# EasyEDA Pro project kuafu01_030内部老化方案.eprj, board PCB4 (continued)
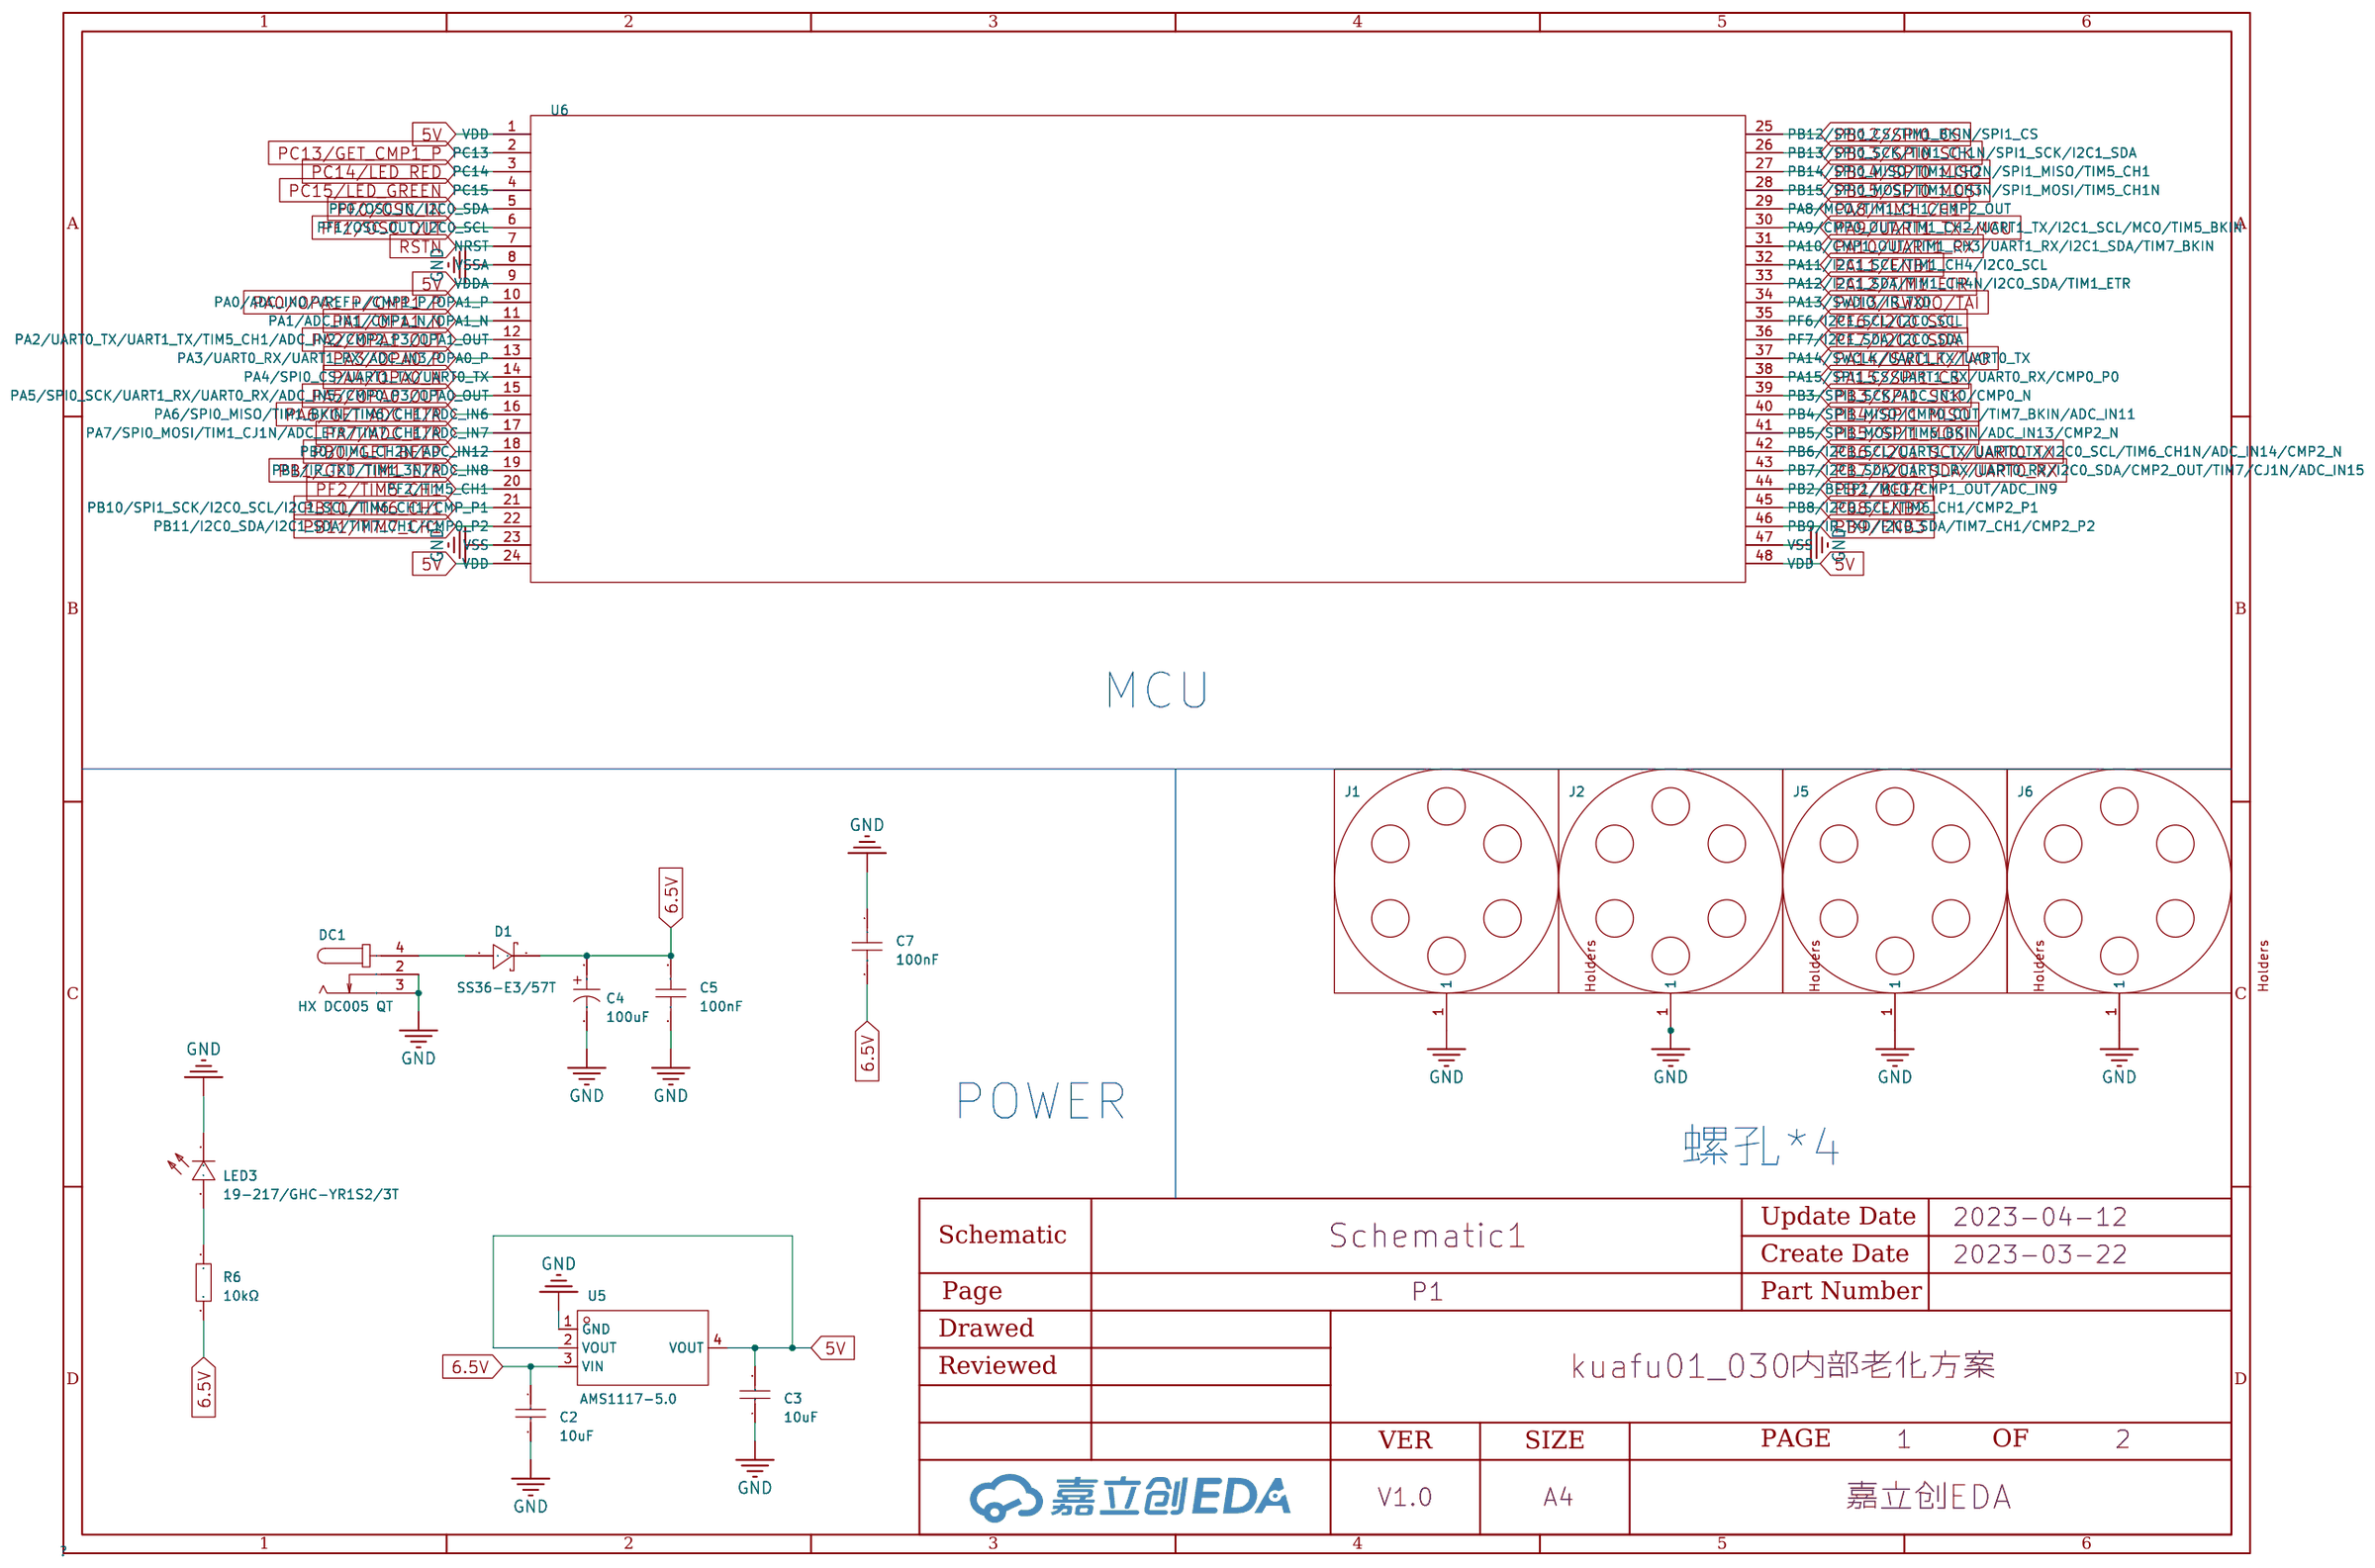
[diagram p0: P1]
## Routing (per net, layer and track width the routed paths; a pad name or vN(x,y) marks a point on that pad's centre or on a via; arc(x,y) is an arc through that point) (continued)
  Bottom Layer w0.254: v1(256.12,86.45) 256.06,86.39 253.49,86.39 v1(253.48,86.4) ; v1(205.32,35.65) 205.26,35.59 202.69,35.59 v1(202.68,35.6) ; v1(306.92,340.45) 306.86,340.39 304.29,340.39 v1(304.28,340.4) ; v1(101.08,137.2) 101.09,137.19 103.66,137.19 v1(103.72,137.25) ; v1(154.52,35.65) 154.46,35.59 151.89,35.59 v1(151.88,35.6) ; v1(103.72,238.85) 103.66,238.79 101.09,238.79 v1(101.08,238.8) ; v1(52.92,238.85) 52.86,238.79 50.29,238.79 v1(50.28,238.8) ; v1(306.92,137.25) 306.86,137.19 304.29,137.19 v1(304.28,137.2) ; v1(154.52,340.45) 154.46,340.39 151.89,340.39 v1(151.88,340.4) ; v1(256.12,289.65) 256.06,289.59 253.49,289.59 v1(253.48,289.6) ; v1(202.68,238.8) 202.69,238.79 205.26,238.79 v1(205.32,238.85) ; v1(154.52,86.45) 154.46,86.39 151.89,86.39 v1(151.88,86.4) ; v1(151.88,238.8) 151.89,238.79 154.46,238.79 v1(154.52,238.85) ; v1(50.28,137.2) 50.29,137.19 52.86,137.19 v1(52.92,137.25) ; v1(256.12,35.65) 256.06,35.59 253.49,35.59 v1(253.48,35.6) ; v1(253.48,137.2) 253.49,137.19 256.06,137.19 v1(256.12,137.25) ; v1(304.28,289.6) 304.29,289.59 306.86,289.59 v1(306.92,289.65) ; v1(306.92,86.45) 306.86,86.39 304.29,86.39 v1(304.28,86.4) ; v1(306.92,188.05) 306.86,187.99 304.29,187.99 v1(304.28,188) ; v1(151.88,137.2) 151.89,137.19 154.46,137.19 v1(154.52,137.25) ; v1(202.68,188) 202.69,187.99 205.26,187.99 v1(205.32,188.05) ; v1(205.32,86.45) 205.26,86.39 202.69,86.39 v1(202.68,86.4) ; v1(256.12,188.05) 256.06,187.99 253.49,187.99 v1(253.48,188) ; v1(256.12,238.85) 256.06,238.79 253.49,238.79 v1(253.48,238.8) ; v1(101.08,188) 101.09,187.99 103.66,187.99 v1(103.72,188.05) ; v1(101.08,289.6) 101.09,289.59 103.66,289.59 v1(103.72,289.65) ; v1(50.28,188) 50.29,187.99 52.86,187.99 v1(52.92,188.05) ; v1(103.72,35.65) 103.66,35.59 101.09,35.59 v1(101.08,35.6) ; v1(103.72,340.45) 103.66,340.39 101.09,340.39 v1(101.08,340.4) ; v1(202.68,340.4) 202.69,340.39 205.26,340.39 v1(205.32,340.45) ; v1(306.92,238.85) 306.86,238.79 304.29,238.79 v1(304.28,238.8) ; v1(52.92,289.65) 52.86,289.59 50.29,289.59 v1(50.28,289.6) ; v1(52.92,35.65) 52.86,35.59 50.29,35.59 v1(50.28,35.6) ; v1(151.88,188) 151.89,187.99 154.46,187.99 v1(154.52,188.05) ; v1(202.68,137.2) 202.69,137.19 205.26,137.19 v1(205.32,137.25) ; v1(103.72,86.45) 103.66,86.39 101.09,86.39 v1(101.08,86.4) ; v1(205.32,289.65) 205.26,289.59 202.69,289.59 v1(202.68,289.6) ; v1(52.92,86.45) 52.86,86.39 50.29,86.39 v1(50.28,86.4) ; v1(151.88,289.6) 151.89,289.59 154.46,289.59 v1(154.52,289.65) ; v1(256.12,340.45) 256.06,340.39 253.49,340.39 v1(253.48,340.4)
PB8/ENB2: length 540.1
  Top Layer w0.254: 304.39,133.1 304.39,134.36 304.06,134.69 304.06,135.22 v1(304.19,135.35) ; 253.59,336.3 253.59,337.56 253.26,337.89 253.26,338.42 v1(253.39,338.55) ; v1(157.11,81.58) 157.59,82.06 158.67,82.06 159.73,81.01 160.67,81.01 ; v1(50.19,135.35) 50.06,135.22 50.06,134.69 50.39,134.36 50.39,133.1 ; v1(253.39,135.35) 253.26,135.22 253.26,134.69 253.59,134.36 253.59,133.1 ; 313.07,335.01 312.13,335.01 311.07,336.06 309.99,336.06 v1(309.51,335.58) ; v1(309.51,233.98) 309.99,234.46 311.07,234.46 312.13,233.41 313.07,233.41 ; v1(258.71,132.38) 259.19,132.86 260.27,132.86 261.33,131.81 262.27,131.81 ; 202.79,285.5 202.79,286.76 202.46,287.09 202.46,287.62 v1(202.59,287.75) ; v1(309.51,284.78) 309.99,285.26 311.07,285.26 312.13,284.21 313.07,284.21 ; v1(50.19,236.95) 50.06,236.82 50.06,236.29 50.39,235.96 50.39,234.7 ; v1(157.11,284.78) 157.59,285.26 158.67,285.26 159.73,284.21 160.67,284.21 ; 59.07,284.21 58.13,284.21 57.07,285.26 55.99,285.26 v1(55.51,284.78) ; v1(202.59,33.75) 202.46,33.62 202.46,33.09 202.79,32.76 202.79,31.5 ; 151.99,183.9 151.99,185.16 151.66,185.49 151.66,186.02 v1(151.79,186.15) ; v1(202.59,338.55) 202.46,338.42 202.46,337.89 202.79,337.56 202.79,336.3 ; 211.47,335.01 210.53,335.01 209.47,336.06 208.39,336.06 v1(207.91,335.58) ; v1(207.91,183.18) 208.39,183.66 209.47,183.66 210.53,182.61 211.47,182.61 ; 101.19,82.3 101.19,83.56 100.86,83.89 100.86,84.42 v1(100.99,84.55) ; v1(106.31,81.58) 106.79,82.06 107.87,82.06 108.93,81.01 109.87,81.01 ; v1(258.71,335.58) 259.19,336.06 260.27,336.06 261.33,335.01 262.27,335.01 ; v1(100.99,33.75) 100.86,33.62 100.86,33.09 101.19,32.76 101.19,31.5 ; 151.99,336.3 151.99,337.56 151.66,337.89 151.66,338.42 v1(151.79,338.55) ; v1(106.31,284.78) 106.79,285.26 107.87,285.26 108.93,284.21 109.87,284.21 ; v1(157.11,233.98) 157.59,234.46 158.67,234.46 159.73,233.41 160.67,233.41 ; 304.39,183.9 304.39,185.16 304.06,185.49 304.06,186.02 v1(304.19,186.15) ; v1(151.79,84.55) 151.66,84.42 151.66,83.89 151.99,83.56 151.99,82.3 ; 59.07,81.01 58.13,81.01 57.07,82.06 55.99,82.06 v1(55.51,81.58) ; 109.87,30.21 108.93,30.21 107.87,31.26 106.79,31.26 v1(106.31,30.78) ; v1(207.91,233.98) 208.39,234.46 209.47,234.46 210.53,233.41 211.47,233.41 ; 262.27,81.01 261.33,81.01 260.27,82.06 259.19,82.06 v1(258.71,81.58) ; v1(106.31,233.98) 106.79,234.46 107.87,234.46 108.93,233.41 109.87,233.41 ; v1(258.71,183.18) 259.19,183.66 260.27,183.66 261.33,182.61 262.27,182.61 ; 202.79,82.3 202.79,83.56 202.46,83.89 202.46,84.42 v1(202.59,84.55) ; 160.67,30.21 159.73,30.21 158.67,31.26 157.59,31.26 v1(157.11,30.78) ; v1(202.59,135.35) 202.46,135.22 202.46,134.69 202.79,134.36 202.79,133.1 ; v1(151.79,33.75) 151.66,33.62 151.66,33.09 151.99,32.76 151.99,31.5 ; v1(253.39,287.75) 253.26,287.62 253.26,287.09 253.59,286.76 253.59,285.5 ; v1(309.51,81.58) 309.99,82.06 311.07,82.06 312.13,81.01 313.07,81.01 ; 304.39,285.5 304.39,286.76 304.06,287.09 304.06,287.62 v1(304.19,287.75) ; v1(100.99,236.95) 100.86,236.82 100.86,236.29 101.19,235.96 101.19,234.7 ; 59.07,182.61 58.13,182.61 57.07,183.66 55.99,183.66 v1(55.51,183.18) ; 50.39,183.9 50.39,185.16 50.06,185.49 50.06,186.02 v1(50.19,186.15) ; v1(151.79,236.95) 151.66,236.82 151.66,236.29 151.99,235.96 151.99,234.7 ; v1(100.99,287.75) 100.86,287.62 100.86,287.09 101.19,286.76 101.19,285.5 ; v1(106.31,132.38) 106.79,132.86 107.87,132.86 108.93,131.81 109.87,131.81 ; v1(258.71,284.78) 259.19,285.26 260.27,285.26 261.33,284.21 262.27,284.21 ; v1(309.51,132.38) 309.99,132.86 311.07,132.86 312.13,131.81 313.07,131.81 ; v1(157.11,183.18) 157.59,183.66 158.67,183.66 159.73,182.61 160.67,182.61 ; v1(100.99,186.15) 100.86,186.02 100.86,185.49 101.19,185.16 101.19,183.9 ; 202.79,183.9 202.79,185.16 202.46,185.49 202.46,186.02 v1(202.59,186.15) ; 50.39,31.5 50.39,32.76 50.06,33.09 50.06,33.62 v1(50.19,33.75) ; 253.59,31.5 253.59,32.76 253.26,33.09 253.26,33.62 v1(253.39,33.75) ; 151.99,133.1 151.99,134.36 151.66,134.69 151.66,135.22 v1(151.79,135.35) ; v1(50.19,287.75) 50.06,287.62 50.06,287.09 50.39,286.76 50.39,285.5 ; 211.47,30.21 210.53,30.21 209.47,31.26 208.39,31.26 v1(207.91,30.78) ; v1(304.19,236.95) 304.06,236.82 304.06,236.29 304.39,235.96 304.39,234.7 ; v1(207.91,132.38) 208.39,132.86 209.47,132.86 210.53,131.81 211.47,131.81 ; 160.67,335.01 159.73,335.01 158.67,336.06 157.59,336.06 v1(157.11,335.58) ; 262.27,233.41 261.33,233.41 260.27,234.46 259.19,234.46 v1(258.71,233.98) ; v1(55.51,132.38) 55.99,132.86 57.07,132.86 58.13,131.81 59.07,131.81 ; v1(304.19,84.55) 304.06,84.42 304.06,83.89 304.39,83.56 304.39,82.3 ; 101.19,133.1 101.19,134.36 100.86,134.69 100.86,135.22 v1(100.99,135.35) ; 313.07,182.61 312.13,182.61 311.07,183.66 309.99,183.66 v1(309.51,183.18) ; v1(50.19,84.55) 50.06,84.42 50.06,83.89 50.39,83.56 50.39,82.3 ; v1(55.51,233.98) 55.99,234.46 57.07,234.46 58.13,233.41 59.07,233.41 ; v1(304.19,338.55) 304.06,338.42 304.06,337.89 304.39,337.56 304.39,336.3 ; 262.27,30.21 261.33,30.21 260.27,31.26 259.19,31.26 v1(258.71,30.78) ; v1(55.51,30.78) 55.99,31.26 57.07,31.26 58.13,30.21 59.07,30.21 ; v1(253.39,84.55) 253.26,84.42 253.26,83.89 253.59,83.56 253.59,82.3 ; 211.47,81.01 210.53,81.01 209.47,82.06 208.39,82.06 v1(207.91,81.58) ; 101.19,336.3 101.19,337.56 100.86,337.89 100.86,338.42 v1(100.99,338.55) ; v1(106.31,183.18) 106.79,183.66 107.87,183.66 108.93,182.61 109.87,182.61 ; v1(151.79,287.75) 151.66,287.62 151.66,287.09 151.99,286.76 151.99,285.5 ; v1(253.39,236.95) 253.26,236.82 253.26,236.29 253.59,235.96 253.59,234.7 ; 211.47,284.21 210.53,284.21 209.47,285.26 208.39,285.26 v1(207.91,284.78) ; 253.59,183.9 253.59,185.16 253.26,185.49 253.26,186.02 v1(253.39,186.15) ; v1(157.11,132.38) 157.59,132.86 158.67,132.86 159.73,131.81 160.67,131.81 ; v1(202.59,236.95) 202.46,236.82 202.46,236.29 202.79,235.96 202.79,234.7 ; 109.87,335.01 108.93,335.01 107.87,336.06 106.79,336.06 v1(106.31,335.58)
  Bottom Layer w0.254: v1(157.11,233.98) 156.73,233.98 153.39,237.32 152.16,237.32 v1(151.79,236.95) ; v1(151.79,135.35) 152.16,135.72 153.39,135.72 156.73,132.38 v1(157.11,132.38) ; v1(202.59,287.75) 202.96,288.12 204.19,288.12 207.53,284.78 v1(207.91,284.78) ; v1(207.91,30.78) 207.53,30.78 204.19,34.12 202.96,34.12 v1(202.59,33.75) ; v1(309.51,284.78) 309.13,284.78 305.79,288.12 304.56,288.12 v1(304.19,287.75) ; v1(304.19,135.35) 304.56,135.72 305.79,135.72 309.13,132.38 v1(309.51,132.38) ; v1(100.99,287.75) 101.36,288.12 102.59,288.12 105.93,284.78 v1(106.31,284.78) ; v1(258.71,183.18) 258.33,183.18 254.99,186.52 253.76,186.52 v1(253.39,186.15) ; v1(50.19,186.15) 50.56,186.52 51.79,186.52 55.13,183.18 v1(55.51,183.18) ; v1(309.51,183.18) 309.13,183.18 305.79,186.52 304.56,186.52 v1(304.19,186.15) ; v1(202.59,338.55) 202.96,338.92 204.19,338.92 207.53,335.58 v1(207.91,335.58) ; v1(100.99,135.35) 101.36,135.72 102.59,135.72 105.93,132.38 v1(106.31,132.38) ; v1(207.91,81.58) 207.53,81.58 204.19,84.92 202.96,84.92 v1(202.59,84.55) ; v1(207.91,132.38) 207.53,132.38 204.19,135.72 202.96,135.72 v1(202.59,135.35) ; v1(55.51,132.38) 55.13,132.38 51.79,135.72 50.56,135.72 v1(50.19,135.35) ; v1(304.19,338.55) 304.56,338.92 305.79,338.92 309.13,335.58 v1(309.51,335.58) ; v1(258.71,132.38) 258.33,132.38 254.99,135.72 253.76,135.72 v1(253.39,135.35) ; v1(253.39,338.55) 253.76,338.92 254.99,338.92 258.33,335.58 v1(258.71,335.58) ; v1(106.31,233.98) 105.93,233.98 102.59,237.32 101.36,237.32 v1(100.99,236.95) ; v1(106.31,81.58) 105.93,81.58 102.59,84.92 101.36,84.92 v1(100.99,84.55) ; v1(157.11,284.78) 156.73,284.78 153.39,288.12 152.16,288.12 v1(151.79,287.75) ; v1(151.79,84.55) 152.16,84.92 153.39,84.92 156.73,81.58 v1(157.11,81.58) ; v1(50.19,84.55) 50.56,84.92 51.79,84.92 55.13,81.58 v1(55.51,81.58) ; v1(157.11,335.58) 156.73,335.58 153.39,338.92 152.16,338.92 v1(151.79,338.55) ; v1(151.79,33.75) 152.16,34.12 153.39,34.12 156.73,30.78 v1(157.11,30.78) ; v1(253.39,236.95) 253.76,237.32 254.99,237.32 258.33,233.98 v1(258.71,233.98) ; v1(151.79,186.15) 152.16,186.52 153.39,186.52 156.73,183.18 v1(157.11,183.18) ; v1(253.39,287.75) 253.76,288.12 254.99,288.12 258.33,284.78 v1(258.71,284.78) ; v1(55.51,284.78) 55.13,284.78 51.79,288.12 50.56,288.12 v1(50.19,287.75) ; v1(258.71,81.58) 258.33,81.58 254.99,84.92 253.76,84.92 v1(253.39,84.55) ; v1(100.99,338.55) 101.36,338.92 102.59,338.92 105.93,335.58 v1(106.31,335.58) ; v1(309.51,233.98) 309.13,233.98 305.79,237.32 304.56,237.32 v1(304.19,236.95) ; v1(253.39,33.75) 253.76,34.12 254.99,34.12 258.33,30.78 v1(258.71,30.78) ; v1(100.99,33.75) 101.36,34.12 102.59,34.12 105.93,30.78 v1(106.31,30.78) ; v1(55.51,233.98) 55.13,233.98 51.79,237.32 50.56,237.32 v1(50.19,236.95) ; v1(309.51,81.58) 309.13,81.58 305.79,84.92 304.56,84.92 v1(304.19,84.55) ; v1(100.99,186.15) 101.36,186.52 102.59,186.52 105.93,183.18 v1(106.31,183.18) ; v1(50.19,33.75) 50.56,34.12 51.79,34.12 55.13,30.78 v1(55.51,30.78) ; v1(207.91,183.18) 207.53,183.18 204.19,186.52 202.96,186.52 v1(202.59,186.15) ; v1(202.59,236.95) 202.96,237.32 204.19,237.32 207.53,233.98 v1(207.91,233.98)
PB9/ENB3: length 209.8
  Top Layer w0.254: 100.69,132.8 100.69,134.23 100.42,134.5 96.99,134.5 ; 147.79,337.7 151.22,337.7 151.49,337.43 151.49,336 ; 202.29,31.2 202.29,32.63 202.02,32.9 198.59,32.9 ; 303.89,336 303.89,337.43 303.62,337.7 300.19,337.7 ; 198.59,286.9 202.02,286.9 202.29,286.63 202.29,285.2 ; 147.79,236.1 151.22,236.1 151.49,235.83 151.49,234.4 ; 198.59,236.1 202.02,236.1 202.29,235.83 202.29,234.4 ; 198.59,337.7 202.02,337.7 202.29,337.43 202.29,336 ; 202.29,82 202.29,83.43 202.02,83.7 198.59,83.7 ; 46.19,185.3 49.62,185.3 49.89,185.03 49.89,183.6 ; 147.79,185.3 151.22,185.3 151.49,185.03 151.49,183.6 ; 96.99,83.7 100.42,83.7 100.69,83.43 100.69,82 ; 46.19,286.9 49.62,286.9 49.89,286.63 49.89,285.2 ; 253.09,336 253.09,337.43 252.82,337.7 249.39,337.7 ; 96.99,236.1 100.42,236.1 100.69,235.83 100.69,234.4 ; 96.99,286.9 100.42,286.9 100.69,286.63 100.69,285.2 ; 100.69,31.2 100.69,32.63 100.42,32.9 96.99,32.9 ; 147.79,32.9 151.22,32.9 151.49,32.63 151.49,31.2 ; 49.89,234.4 49.89,235.83 49.62,236.1 46.19,236.1 ; 253.09,234.4 253.09,235.83 252.82,236.1 249.39,236.1 ; 303.89,82 303.89,83.43 303.62,83.7 300.19,83.7 ; 300.19,236.1 303.62,236.1 303.89,235.83 303.89,234.4 ; 100.69,183.6 100.69,185.03 100.42,185.3 96.99,185.3 ; 300.19,185.3 303.62,185.3 303.89,185.03 303.89,183.6 ; 202.29,183.6 202.29,185.03 202.02,185.3 198.59,185.3 ; 147.79,286.9 151.22,286.9 151.49,286.63 151.49,285.2 ; 249.39,286.9 252.82,286.9 253.09,286.63 253.09,285.2 ; 198.59,134.5 202.02,134.5 202.29,134.23 202.29,132.8 ; 300.19,134.5 303.62,134.5 303.89,134.23 303.89,132.8 ; 96.99,337.7 100.42,337.7 100.69,337.43 100.69,336 ; 253.09,183.6 253.09,185.03 252.82,185.3 249.39,185.3 ; 249.39,83.7 252.82,83.7 253.09,83.43 253.09,82 ; 300.19,286.9 303.62,286.9 303.89,286.63 303.89,285.2 ; 49.89,82 49.89,83.43 49.62,83.7 46.19,83.7 ; 253.09,31.2 253.09,32.63 252.82,32.9 249.39,32.9 ; 151.49,132.8 151.49,134.23 151.22,134.5 147.79,134.5 ; 46.19,32.9 49.62,32.9 49.89,32.63 49.89,31.2 ; 46.19,134.5 49.62,134.5 49.89,134.23 49.89,132.8 ; 253.09,132.8 253.09,134.23 252.82,134.5 249.39,134.5 ; 147.79,83.7 151.22,83.7 151.49,83.43 151.49,82
PB10/TIM6_CH1: length 19.7
  Top Layer w0.254: 205.29,124.16 205.78,124.16 ; 205.29,73.36 205.78,73.36 ; 52.89,276.56 53.38,276.56 ; 306.89,276.56 307.38,276.56 ; 256.09,225.76 256.58,225.76 ; 103.69,327.36 104.18,327.36 ; 103.69,124.16 104.18,124.16 ; 103.69,276.56 104.18,276.56 ; 154.49,73.36 154.98,73.36 ; 52.89,174.96 53.38,174.96 ; 103.69,73.36 104.18,73.36 ; 256.09,73.36 256.58,73.36 ; 205.29,22.56 205.78,22.56 ; 306.89,225.76 307.38,225.76 ; 154.49,327.36 154.98,327.36 ; 256.09,124.16 256.58,124.16 ; 154.49,276.56 154.98,276.56 ; 52.89,124.16 53.38,124.16 ; 154.49,174.96 154.98,174.96 ; 306.89,174.96 307.38,174.96 ; 103.69,174.96 104.18,174.96 ; 52.89,73.36 53.38,73.36 ; 52.89,225.76 53.38,225.76 ; 306.89,327.36 307.38,327.36 ; 154.49,225.76 154.98,225.76 ; 306.89,73.36 307.38,73.36 ; 103.69,225.76 104.18,225.76 ; 154.49,22.56 154.98,22.56 ; 52.89,22.56 53.38,22.56 ; 205.29,225.76 205.78,225.76 ; 256.09,276.56 256.58,276.56 ; 256.09,327.36 256.58,327.36 ; 103.69,22.56 104.18,22.56 ; 154.49,124.16 154.98,124.16 ; 256.09,174.96 256.58,174.96 ; 256.09,22.56 256.58,22.56 ; 306.89,124.16 307.38,124.16 ; 205.29,327.36 205.78,327.36 ; 205.29,276.56 205.78,276.56 ; 205.29,174.96 205.78,174.96
PB13/SPI0_SCK: length 1542.4
  Top Layer w0.254: 55.9,75.29 66.11,75.29 v1(67.25,76.43) ; v1(269.26,238.67) 268.72,238.67 267.2,237.15 257.84,237.15 256.61,235.92 256.61,234.4 ; 157.5,75.29 167.71,75.29 v1(168.85,76.43) ; 259.1,227.69 269.31,227.69 v1(270.45,228.83) ; v1(219.65,228.83) 218.51,227.69 208.3,227.69 ; 256.61,82 256.61,83.52 257.84,84.75 267.2,84.75 268.72,86.27 v1(269.26,86.27) ; v1(167.66,289.47) 167.12,289.47 165.6,287.95 156.24,287.95 155.01,286.72 155.01,285.2 ; v1(167.66,340.27) 167.12,340.27 165.6,338.75 156.24,338.75 155.01,337.52 155.01,336 ; 307.41,336 307.41,337.52 308.64,338.75 318,338.75 319.52,340.27 v1(320.06,340.27) ; 259.1,278.49 269.31,278.49 v1(270.45,279.63) ; v1(218.46,35.47) 217.92,35.47 216.4,33.95 207.04,33.95 205.81,32.72 205.81,31.2 ; 104.21,285.2 104.21,286.72 105.44,287.95 114.8,287.95 116.32,289.47 v1(116.86,289.47) ; v1(219.65,178.03) 218.51,176.89 208.3,176.89 ; 309.9,227.69 320.11,227.69 v1(321.25,228.83) ; v1(219.65,76.43) 218.51,75.29 208.3,75.29 ; v1(167.66,86.27) 167.12,86.27 165.6,84.75 156.24,84.75 155.01,83.52 155.01,82 ; v1(168.85,330.43) 167.71,329.29 157.5,329.29 ; 53.41,285.2 53.41,286.72 54.64,287.95 64,287.95 65.52,289.47 v1(66.06,289.47) ; v1(168.85,228.83) 167.71,227.69 157.5,227.69 ; v1(116.86,35.47) 116.32,35.47 114.8,33.95 105.44,33.95 104.21,32.72 104.21,31.2 ; 104.21,234.4 104.21,235.92 105.44,237.15 114.8,237.15 116.32,238.67 v1(116.86,238.67) ; v1(219.65,330.43) 218.51,329.29 208.3,329.29 ; v1(269.26,35.47) 268.72,35.47 267.2,33.95 257.84,33.95 256.61,32.72 256.61,31.2 ; v1(269.26,137.07) 268.72,137.07 267.2,135.55 257.84,135.55 256.61,134.32 256.61,132.8 ; 157.5,176.89 167.71,176.89 v1(168.85,178.03) ; 55.9,176.89 66.11,176.89 v1(67.25,178.03) ; 53.41,132.8 53.41,134.32 54.64,135.55 64,135.55 65.52,137.07 v1(66.06,137.07) ; 106.7,176.89 116.91,176.89 v1(118.05,178.03) ; v1(321.25,279.63) 320.11,278.49 309.9,278.49 ; v1(116.86,340.27) 116.32,340.27 114.8,338.75 105.44,338.75 104.21,337.52 104.21,336 ; 155.01,31.2 155.01,32.72 156.24,33.95 165.6,33.95 167.12,35.47 v1(167.66,35.47) ; 205.81,183.6 205.81,185.12 207.04,186.35 216.4,186.35 217.92,187.87 v1(218.46,187.87) ; 259.1,176.89 269.31,176.89 v1(270.45,178.03) ; v1(118.05,76.43) 116.91,75.29 106.7,75.29 ; 53.41,31.2 53.41,32.72 54.64,33.95 64,33.95 65.52,35.47 v1(66.06,35.47) ; v1(168.85,279.63) 167.71,278.49 157.5,278.49 ; v1(218.46,137.07) 217.92,137.07 216.4,135.55 207.04,135.55 205.81,134.32 205.81,132.8 ; v1(270.45,330.43) 269.31,329.29 259.1,329.29 ; v1(219.65,25.63) 218.51,24.49 208.3,24.49 ; v1(118.05,228.83) 116.91,227.69 106.7,227.69 ; v1(66.06,187.87) 65.52,187.87 64,186.35 54.64,186.35 53.41,185.12 53.41,183.6 ; v1(167.66,137.07) 167.12,137.07 165.6,135.55 156.24,135.55 155.01,134.32 155.01,132.8 ; 106.7,24.49 116.91,24.49 v1(118.05,25.63) ; v1(67.25,25.63) 66.11,24.49 55.9,24.49 ; 55.9,126.09 66.11,126.09 v1(67.25,127.23) ; v1(219.65,127.23) 218.51,126.09 208.3,126.09 ; v1(321.25,178.03) 320.11,176.89 309.9,176.89 ; 53.41,234.4 53.41,235.92 54.64,237.15 64,237.15 65.52,238.67 v1(66.06,238.67) ; 104.21,82 104.21,83.52 105.44,84.75 114.8,84.75 116.32,86.27 v1(116.86,86.27) ; 106.7,329.29 116.91,329.29 v1(118.05,330.43) ; v1(320.06,187.87) 319.52,187.87 318,186.35 308.64,186.35 307.41,185.12 307.41,183.6 ; v1(67.25,279.63) 66.11,278.49 55.9,278.49 ; 205.81,336 205.81,337.52 207.04,338.75 216.4,338.75 217.92,340.27 v1(218.46,340.27) ; v1(66.06,86.27) 65.52,86.27 64,84.75 54.64,84.75 53.41,83.52 53.41,82 ; 309.9,329.29 320.11,329.29 v1(321.25,330.43) ; v1(321.25,76.43) 320.11,75.29 309.9,75.29 ; 55.9,227.69 66.11,227.69 v1(67.25,228.83) ; v1(118.05,279.63) 116.91,278.49 106.7,278.49 ; 307.41,132.8 307.41,134.32 308.64,135.55 318,135.55 319.52,137.07 v1(320.06,137.07) ; 309.9,126.09 320.11,126.09 v1(321.25,127.23) ; v1(320.06,238.67) 319.52,238.67 318,237.15 308.64,237.15 307.41,235.92 307.41,234.4 ; v1(116.86,187.87) 116.32,187.87 114.8,186.35 105.44,186.35 104.21,185.12 104.21,183.6 ; 259.1,24.49 269.31,24.49 v1(270.45,25.63) ; 157.5,24.49 167.71,24.49 v1(168.85,25.63) ; v1(320.06,86.27) 319.52,86.27 318,84.75 308.64,84.75 307.41,83.52 307.41,82 ; v1(269.26,289.47) 268.72,289.47 267.2,287.95 257.84,287.95 256.61,286.72 256.61,285.2 ; v1(218.46,86.27) 217.92,86.27 216.4,84.75 207.04,84.75 205.81,83.52 205.81,82 ; v1(320.06,289.47) 319.52,289.47 318,287.95 308.64,287.95 307.41,286.72 307.41,285.2 ; v1(219.65,279.63) 218.51,278.49 208.3,278.49 ; v1(167.66,238.67) 167.12,238.67 165.6,237.15 156.24,237.15 155.01,235.92 155.01,234.4 ; 256.61,183.6 256.61,185.12 257.84,186.35 267.2,186.35 268.72,187.87 v1(269.26,187.87) ; v1(168.85,127.23) 167.71,126.09 157.5,126.09 ; 205.81,285.2 205.81,286.72 207.04,287.95 216.4,287.95 217.92,289.47 v1(218.46,289.47) ; v1(218.46,238.67) 217.92,238.67 216.4,237.15 207.04,237.15 205.81,235.92 205.81,234.4 ; 259.1,126.09 269.31,126.09 v1(270.45,127.23) ; 155.01,183.6 155.01,185.12 156.24,186.35 165.6,186.35 167.12,187.87 v1(167.66,187.87) ; 104.21,132.8 104.21,134.32 105.44,135.55 114.8,135.55 116.32,137.07 v1(116.86,137.07) ; v1(270.45,76.43) 269.31,75.29 259.1,75.29 ; v1(118.05,127.23) 116.91,126.09 106.7,126.09 ; v1(269.26,340.27) 268.72,340.27 267.2,338.75 257.84,338.75 256.61,337.52 256.61,336
  Bottom Layer w0.254: v1(67.25,76.43) 68.26,77.45 68.26,84.51 66.51,86.27 v1(66.06,86.27) ; v1(269.26,289.47) 269.71,289.47 271.46,287.71 271.46,280.65 v1(270.45,279.63) ; v1(270.45,330.43) 271.46,331.45 271.46,338.51 269.71,340.27 v1(269.26,340.27) ; v1(167.66,340.27) 168.11,340.27 169.86,338.51 169.86,331.45 v1(168.85,330.43) ; v1(168.85,76.43) 169.86,77.45 169.86,84.51 168.11,86.27 v1(167.66,86.27) ; v1(219.65,178.03) 220.66,179.05 220.66,186.12 218.91,187.87 v1(218.46,187.87) ; v1(219.65,279.63) 220.66,280.65 220.66,287.71 218.91,289.47 v1(218.46,289.47) ; v1(270.45,178.03) 271.46,179.05 271.46,186.12 269.71,187.87 v1(269.26,187.87) ; v1(270.45,127.23) 271.46,128.25 271.46,135.31 269.71,137.07 v1(269.26,137.07) ; v1(270.45,228.83) 271.46,229.85 271.46,236.91 269.71,238.67 v1(269.26,238.67) ; v1(320.06,86.27) 320.51,86.27 322.26,84.51 322.26,77.45 v1(321.25,76.43) ; v1(218.46,340.27) 218.91,340.27 220.66,338.51 220.66,331.45 v1(219.65,330.43) ; v1(218.46,238.67) 218.91,238.67 220.66,236.91 220.66,229.85 v1(219.65,228.83) ; v1(116.86,137.07) 117.31,137.07 119.06,135.31 119.06,128.25 v1(118.05,127.23) ; v1(66.06,289.47) 66.51,289.47 68.26,287.71 68.26,280.65 v1(67.25,279.63) ; v1(167.66,238.67) 168.11,238.67 169.86,236.91 169.86,229.85 v1(168.85,228.83) ; v1(167.66,187.87) 168.11,187.87 169.86,186.12 169.86,179.05 v1(168.85,178.03) ; v1(269.26,35.47) 269.71,35.47 271.46,33.71 271.46,26.65 v1(270.45,25.63) ; v1(116.86,86.27) 117.31,86.27 119.06,84.51 119.06,77.45 v1(118.05,76.43) ; v1(321.25,127.23) 322.26,128.25 322.26,135.31 320.51,137.07 v1(320.06,137.07) ; v1(116.86,289.47) 117.31,289.47 119.06,287.71 119.06,280.65 v1(118.05,279.63) ; v1(218.46,35.47) 218.91,35.47 220.66,33.71 220.66,26.65 v1(219.65,25.63) ; v1(219.65,76.43) 220.66,77.45 220.66,84.51 218.91,86.27 v1(218.46,86.27) ; v1(66.06,238.67) 66.51,238.67 68.26,236.91 68.26,229.85 v1(67.25,228.83) ; v1(118.05,178.03) 119.06,179.05 119.06,186.12 117.31,187.87 v1(116.86,187.87) ; v1(168.85,127.23) 169.86,128.25 169.86,135.31 168.11,137.07 v1(167.66,137.07) ; v1(167.66,35.47) 168.11,35.47 169.86,33.71 169.86,26.65 v1(168.85,25.63) ; v1(116.86,340.27) 117.31,340.27 119.06,338.51 119.06,331.45 v1(118.05,330.43) ; v1(118.05,228.83) 119.06,229.85 119.06,236.91 117.31,238.67 v1(116.86,238.67) ; v1(118.05,25.63) 119.06,26.65 119.06,33.71 117.31,35.47 v1(116.86,35.47) ; v1(218.46,137.07) 218.91,137.07 220.66,135.31 220.66,128.25 v1(219.65,127.23) ; v1(167.66,289.47) 168.11,289.47 169.86,287.71 169.86,280.65 v1(168.85,279.63) ; v1(320.06,187.87) 320.51,187.87 322.26,186.12 322.26,179.05 v1(321.25,178.03) ; v1(66.06,35.47) 66.51,35.47 68.26,33.71 68.26,26.65 v1(67.25,25.63) ; v1(270.45,76.43) 271.46,77.45 271.46,84.51 269.71,86.27 v1(269.26,86.27) ; v1(321.25,228.83) 322.26,229.85 322.26,236.91 320.51,238.67 v1(320.06,238.67) ; v1(66.06,137.07) 66.51,137.07 68.26,135.31 68.26,128.25 v1(67.25,127.23) ; v1(66.06,187.87) 66.51,187.87 68.26,186.12 68.26,179.05 v1(67.25,178.03) ; v1(320.06,340.27) 320.51,340.27 322.26,338.51 322.26,331.45 v1(321.25,330.43) ; v1(320.06,289.47) 320.51,289.47 322.26,287.71 322.26,280.65 v1(321.25,279.63)
